# EasyEDA Pro project wukong01-Y003-HTOL.eprj, board PCB1 (continued)
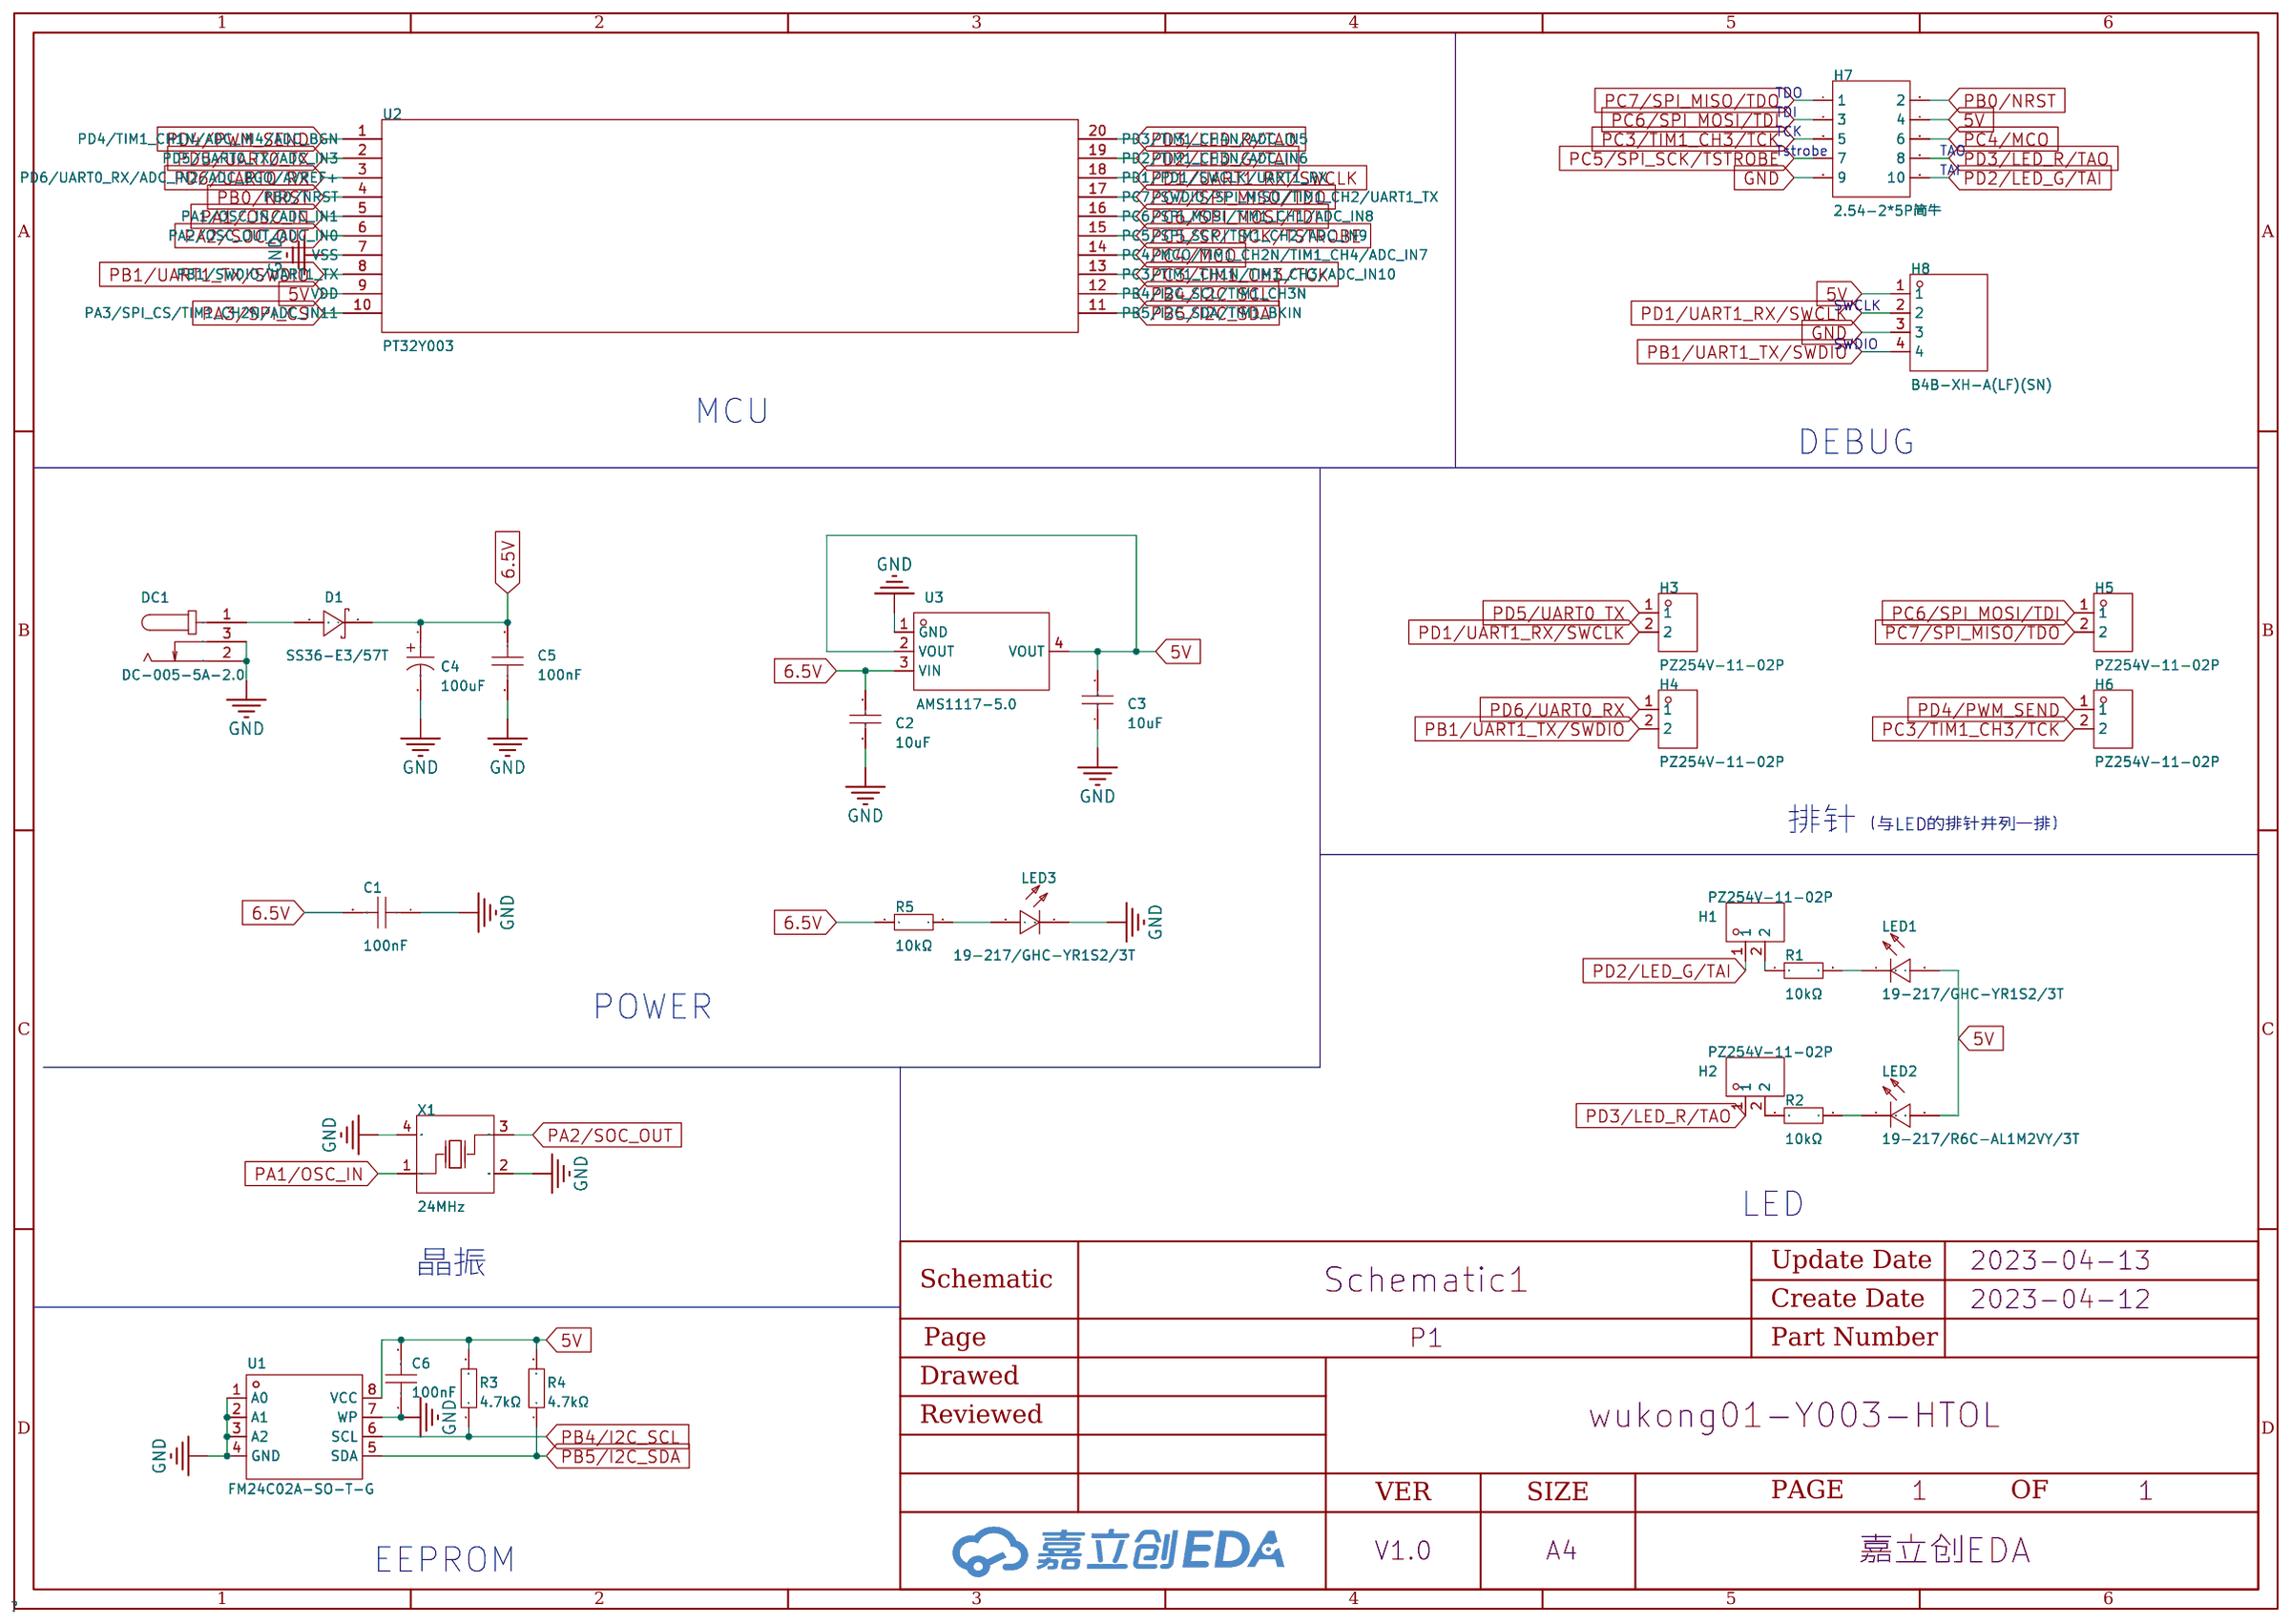
[diagram p0: schematic sheet]
## Routing (per net, layer and track width the routed paths; a pad name or vN(x,y) marks a point on that pad's centre or on a via; arc(x,y) is an arc through that point) (continued)
  Bottom Layer w0.5: v1(36.7,242.32) 36.7,249.43 36.2,249.94 31.24,249.94 30.35,250.83 H8#28.3 ; H8#11.3 30.35,79.12 31.24,78.23 36.2,78.23 36.7,77.72 v1(36.7,70.61) ; v1(157.37,211.46) 157.37,215.9 ; 303.53,87.23 303.53,47.62 300.36,44.45 11.69,44.45 10.3,43.05 v1(10.3,39.75) ; 303.53,87.23 11.56,87.23 10.3,85.97 v1(10.3,82.68) ; 303.53,87.23 303.53,130.28 ; v1(206.39,82.68) 206.39,87.12 ; H8.3 79.38,122.05 80.26,121.16 85.22,121.16 85.72,120.65 v1(85.72,113.54) ; v1(281.81,70.61) 281.81,77.72 281.31,78.23 276.35,78.23 275.46,79.12 H8#14.3 ; v1(206.39,254.38) 206.39,258.83 ; H8#29.3 79.38,207.9 80.26,207.01 85.22,207.01 85.72,206.5 v1(85.72,199.39) ; H8#7.3 79.38,293.75 80.26,292.86 85.22,292.86 85.72,292.35 v1(85.72,285.24) ; 303.53,216.02 11.73,216.02 10.3,214.59 v1(10.3,211.46) ; 303.53,216.02 303.53,258.95 ; 303.53,216.02 303.53,173.04 ; v1(134.75,285.24) 134.75,292.35 134.24,292.86 129.29,292.86 128.4,293.75 H8#9.3 ; H8#4.3 275.46,122.05 276.35,121.16 281.31,121.16 281.81,120.65 v1(281.81,113.54) ; H8#40.3 30.35,164.97 31.24,164.08 36.2,164.08 36.7,163.58 v1(36.7,156.46) ; v1(281.81,199.39) 281.81,206.5 281.31,207.01 276.35,207.01 275.46,207.9 H8#32.3 ; v1(183.77,27.69) 183.77,34.8 183.26,35.31 178.31,35.31 177.42,36.2 H8#19.3 ; H8#2.3 177.42,122.05 178.31,121.16 183.26,121.16 183.77,120.65 v1(183.77,113.54) ; v1(157.37,82.68) 157.37,87.12 ; H8#26.3 275.46,250.83 276.35,249.94 281.31,249.94 281.81,249.43 v1(281.81,242.32) ; H8#36.3 177.42,164.97 178.31,164.08 183.26,164.08 183.77,163.58 v1(183.77,156.46) ; H8#37.3 128.4,164.97 129.29,164.08 134.24,164.08 134.75,163.58 v1(134.75,156.46) ; v1(59.32,254.38) 59.32,258.83 ; v1(232.79,285.24) 232.79,292.35 232.28,292.86 227.33,292.86 226.44,293.75 H8#15.3 ; v1(157.37,125.6) 157.37,130.05 ; v1(10.3,125.6) 10.3,128.66 11.92,130.28 303.53,130.28 ; v1(281.81,285.24) 281.81,292.35 281.31,292.86 276.35,292.86 275.46,293.75 H8#10.3 ; v1(157.37,168.53) 157.37,172.97 ; H8#27.3 226.44,250.83 227.33,249.94 232.28,249.94 232.79,249.43 v1(232.79,242.32) ; H8#21.3 226.44,36.2 227.33,35.31 232.28,35.31 232.79,34.8 v1(232.79,27.69) ; v1(85.72,27.69) 85.72,34.8 85.22,35.31 80.26,35.31 79.38,36.2 H8#16.3 ; v1(108.34,211.46) 108.34,215.9 ; H8#39.3 226.44,164.97 227.33,164.08 232.28,164.08 232.79,163.58 v1(232.79,156.46) ; v1(54.1,301.75) 59.32,301.75 ; 59.32,301.75 108.34,301.75 ; 59.32,301.75 v1(59.32,297.31) ; v1(59.32,211.46) 59.32,215.9 ; v1(59.32,125.6) 59.32,130.05 ; 303.53,258.95 39.1,258.95 ; 303.53,258.95 303.53,299.47 301.24,301.75 255.41,301.75 ; 39.1,258.95 11.69,258.95 10.3,257.56 v1(10.3,254.38) ; 39.1,258.95 39.12,258.97 v1(39.12,263.27) v1(27.3,263.27) v1(21.34,263.27) ; v1(59.32,168.53) 59.32,172.97 ; 157.37,301.75 206.39,301.75 ; 157.37,301.75 v1(157.37,297.31) ; 157.37,301.75 108.34,301.75 ; 206.39,301.75 v1(206.39,297.31) ; 206.39,301.75 255.41,301.75 ; H8#34.3 30.35,207.9 31.24,207.01 36.2,207.01 36.7,206.5 v1(36.7,199.39) ; H8#8.3 177.42,293.75 178.31,292.86 183.26,292.86 183.77,292.35 v1(183.77,285.24) ; v1(183.77,199.39) 183.77,206.5 183.26,207.01 178.31,207.01 177.42,207.9 H8#30.3 ; 108.34,301.75 v1(108.34,297.31) ; H8#5.3 226.44,122.05 227.33,121.16 232.28,121.16 232.79,120.65 v1(232.79,113.54) ; v1(108.34,168.53) 108.34,172.97 ; H8#12.3 79.38,79.12 80.26,78.23 85.22,78.23 85.72,77.72 v1(85.72,70.61) ; H8#25.3 128.4,250.83 129.29,249.94 134.24,249.94 134.75,249.43 v1(134.75,242.32) ; H8#33.3 226.44,207.9 227.33,207.01 232.28,207.01 232.79,206.5 v1(232.79,199.39) ; 255.41,301.75 v1(255.41,297.31) ; H8#38.3 275.46,164.97 276.35,164.08 281.31,164.08 281.81,163.58 v1(281.81,156.46) ; v1(206.39,39.75) 206.39,44.2 ; H8#22.3 226.44,79.12 227.33,78.23 232.28,78.23 232.79,77.72 v1(232.79,70.61) ; v1(206.39,211.46) 206.39,215.9 ; 303.53,130.28 303.53,173.04 ; v1(10.3,168.53) 10.3,171.8 11.54,173.04 303.53,173.04 ; H8#31.3 128.4,207.9 129.29,207.01 134.24,207.01 134.75,206.5 v1(134.75,199.39) ; v1(255.41,82.68) 255.41,87.12 ; v1(134.75,113.54) 134.75,120.65 134.24,121.16 129.29,121.16 128.4,122.05 H8#3.3 ; v1(183.77,70.61) 183.77,77.72 183.26,78.23 178.31,78.23 177.42,79.12 H8#13.3 ; v1(85.72,156.46) 85.72,163.58 85.22,164.08 80.26,164.08 79.38,164.97 H8#35.3 ; v1(255.41,168.53) 255.41,172.97 ; H8#17.3 30.35,36.2 31.24,35.31 36.2,35.31 36.7,34.8 v1(36.7,27.69) ; H8#24.3 177.42,250.83 178.31,249.94 183.26,249.94 183.77,249.43 v1(183.77,242.32) ; v1(59.32,39.75) 59.32,44.2 ; v1(255.41,211.46) 255.41,215.9 ; H8#18.3 128.4,79.12 129.29,78.23 134.24,78.23 134.75,77.72 v1(134.75,70.61) ; v1(108.34,39.75) 108.34,44.2 ; v1(255.41,125.6) 255.41,130.05 ; v1(59.32,82.68) 59.32,87.12 ; v1(206.39,125.6) 206.39,130.05 ; v1(157.37,39.75) 157.37,44.2 ; v1(157.37,254.38) 157.37,258.83 ; v1(108.34,254.38) 108.34,258.83 ; v1(36.7,113.54) 36.7,120.65 36.2,121.16 31.24,121.16 30.35,122.05 H8#6.3 ; v1(206.39,168.53) 206.39,172.97 ; v1(108.34,82.68) 108.34,87.12 ; v1(255.41,254.38) 255.41,258.83 ; H8#23.3 79.38,250.83 80.26,249.94 85.22,249.94 85.72,249.43 v1(85.72,242.32) ; v1(134.75,27.69) 134.75,34.8 134.24,35.31 129.29,35.31 128.4,36.2 H8#20.3 ; v1(108.34,125.6) 108.34,130.05
  vias: v1(12.19,248.16) v1(12.19,247.16) v1(12.19,246.16) v1(12.19,75.95) v1(12.19,74.95) v1(12.19,73.95) v1(12.45,163.07) v1(12.45,162.07) v1(12.45,161.07) v1(12.45,119.76) v1(12.45,118.76) v1(12.45,117.76) v1(12.45,33.4) v1(12.45,32.4) v1(12.45,31.4) v1(12.57,204.98) v1(12.57,203.98) v1(12.57,202.98) v1(13.19,248.16) v1(13.19,247.16) v1(13.19,246.16) v1(13.19,75.95) v1(13.19,74.95) v1(13.19,73.95) v1(13.45,163.07) v1(13.45,162.07) v1(13.45,161.07) v1(13.45,119.76) v1(13.45,118.76) v1(13.45,117.76) v1(13.46,42.55) v1(13.46,41.55) v1(13.46,40.55) v1(13.45,33.4) v1(13.45,32.4) v1(13.45,31.4) v1(13.57,204.98) v1(13.57,203.98) v1(13.57,202.98) v1(13.59,128.65) v1(13.59,127.65) v1(13.59,126.65) v1(13.84,215.39) v1(13.84,214.39) v1(13.84,213.39) v1(13.84,86.36) v1(13.84,85.36) v1(13.84,84.36) v1(13.97,258.44) v1(13.97,257.44) v1(13.97,256.44) v1(13.97,171.96) v1(13.97,170.96) v1(13.97,169.96) v1(14.19,248.16) v1(14.19,247.16) v1(14.19,246.16) v1(14.19,75.95) v1(14.19,74.95) v1(14.19,73.95) v1(14.45,163.07) v1(14.45,162.07) v1(14.45,161.07) v1(14.45,119.76) v1(14.45,118.76) v1(14.45,117.76) v1(14.46,42.55) v1(14.46,41.55) v1(14.46,40.55) v1(14.45,33.4) v1(14.45,32.4) v1(14.45,31.4) v1(14.57,204.98) v1(14.57,203.98) v1(14.57,202.98) v1(14.59,128.65) v1(14.59,127.65) v1(14.59,126.65) v1(14.84,215.39) v1(14.84,214.39) v1(14.84,213.39) v1(14.84,86.36) v1(14.84,85.36) v1(14.84,84.36) v1(14.97,258.44) v1(14.97,257.44) v1(14.97,256.44) v1(14.97,171.96) v1(14.97,170.96) v1(14.97,169.96) v1(15.46,42.55) v1(15.46,41.55) v1(15.46,40.55) v1(15.59,128.65) v1(15.59,127.65) v1(15.59,126.65) v1(15.84,215.39) v1(15.84,214.39) v1(15.84,213.39) v1(15.84,86.36) v1(15.84,85.36) v1(15.84,84.36) v1(15.97,258.44) v1(15.97,257.44) v1(15.97,256.44) v1(15.97,171.96) v1(15.97,170.96) v1(15.97,169.96) v1(61.09,162.94) v1(61.09,161.94) v1(61.09,160.94) v1(61.09,77.47) v1(61.09,76.47) v1(61.09,75.47) v1(61.34,248.03) v1(61.34,247.03) v1(61.34,246.03) v1(61.47,33.91) v1(61.47,32.91) v1(61.47,31.91) v1(61.59,119.51) v1(61.59,118.51) v1(61.59,117.51) v1(61.72,205.23) v1(61.72,204.23) v1(61.72,203.23) v1(61.85,290.19) v1(61.85,289.19) v1(61.85,288.19) v1(61.85,42.29) v1(61.85,41.29) v1(61.85,40.29) v1(62.09,162.94) v1(62.09,161.94) v1(62.09,160.94) v1(62.09,77.47) v1(62.09,76.47) v1(62.09,75.47) v1(62.23,171.96) v1(62.23,170.96) v1(62.23,169.96) v1(62.34,248.03) v1(62.34,247.03) v1(62.34,246.03) v1(62.36,215.27) v1(62.36,214.27) v1(62.36,213.27) v1(62.36,85.73) v1(62.36,84.73) v1(62.36,83.73) v1(62.48,129.16) v1(62.48,128.16) v1(62.48,127.16) v1(62.47,33.91) v1(62.47,32.91) v1(62.47,31.91) v1(62.59,119.51) v1(62.59,118.51) v1(62.59,117.51) v1(62.74,258.57) v1(62.74,257.57) v1(62.74,256.57) v1(62.72,205.23) v1(62.72,204.23) v1(62.72,203.23) v1(62.85,290.19) v1(62.85,289.19) v1(62.85,288.19) v1(62.85,42.29) v1(62.85,41.29) v1(62.85,40.29) v1(63.09,162.94) v1(63.09,161.94) v1(63.09,160.94) v1(63.09,77.47) v1(63.09,76.47) v1(63.09,75.47) v1(63.23,171.96) v1(63.23,170.96) v1(63.23,169.96) v1(63.34,248.03) v1(63.34,247.03) v1(63.34,246.03) v1(63.36,215.27) v1(63.36,214.27) v1(63.36,213.27) v1(63.36,85.73) v1(63.36,84.73) v1(63.36,83.73) v1(63.48,129.16) v1(63.48,128.16) v1(63.48,127.16) v1(63.47,33.91) v1(63.47,32.91) v1(63.47,31.91) v1(63.59,119.51) v1(63.59,118.51) v1(63.59,117.51) v1(63.74,258.57) v1(63.74,257.57) v1(63.74,256.57) v1(63.72,205.23) v1(63.72,204.23) v1(63.72,203.23) v1(63.85,290.19) v1(63.85,289.19) v1(63.85,288.19) v1(63.85,42.29) v1(63.85,41.29) v1(63.85,40.29) v1(64.26,301.24) v1(64.26,300.24) v1(64.26,299.24) v1(64.23,171.96) v1(64.23,170.96) v1(64.23,169.96) v1(64.36,215.27) v1(64.36,214.27) v1(64.36,213.27) v1(64.36,85.73) v1(64.36,84.73) v1(64.36,83.73) v1(64.48,129.16) v1(64.48,128.16) v1(64.48,127.16) v1(64.74,258.57) v1(64.74,257.57) v1(64.74,256.57) v1(65.26,301.24) v1(65.26,300.24) v1(65.26,299.24) v1(66.26,301.24) v1(66.26,300.24) v1(66.26,299.24) v1(110.36,205.74) v1(110.36,204.74) v1(110.36,203.74) v1(110.36,162.43) v1(110.36,161.43) v1(110.36,160.43) v1(110.62,248.54) v1(110.62,247.54) v1(110.62,246.54) v1(110.62,77.09) v1(110.62,76.09) v1(110.62,75.09) v1(110.74,33.91) v1(110.74,32.91) v1(110.74,31.91) v1(110.87,290.96) v1(110.87,289.96) v1(110.87,288.96) v1(110.87,119.63) v1(110.87,118.63) v1(110.87,117.63) v1(111.12,171.83) v1(111.12,170.83) v1(111.12,169.83) v1(111.25,258.57) v1(111.25,257.57) v1(111.25,256.57) v1(111.36,205.74) v1(111.36,204.74) v1(111.36,203.74) v1(111.36,162.43) v1(111.36,161.43) v1(111.36,160.43) v1(111.38,85.22) v1(111.38,84.22) v1(111.38,83.22) v1(111.38,42.29) v1(111.38,41.29) v1(111.38,40.29) v1(111.62,248.54) v1(111.62,247.54) v1(111.62,246.54) v1(111.63,129.41) v1(111.63,128.41) v1(111.63,127.41) v1(111.62,77.09) v1(111.62,76.09) v1(111.62,75.09) v1(111.74,33.91) v1(111.74,32.91) v1(111.74,31.91) v1(111.87,290.96) v1(111.87,289.96) v1(111.87,288.96) v1(111.87,119.63) v1(111.87,118.63) v1(111.87,117.63) v1(112.01,215.39) v1(112.01,214.39) v1(112.01,213.39) v1(112.12,171.83) v1(112.12,170.83) v1(112.12,169.83) v1(112.25,258.57) v1(112.25,257.57) v1(112.25,256.57) v1(112.36,205.74) v1(112.36,204.74) v1(112.36,203.74) v1(112.36,162.43) v1(112.36,161.43) v1(112.36,160.43) v1(112.38,85.22) v1(112.38,84.22) v1(112.38,83.22) v1(112.38,42.29) v1(112.38,41.29) v1(112.38,40.29) v1(112.62,248.54) v1(112.62,247.54) v1(112.62,246.54) v1(112.63,129.41) v1(112.63,128.41) v1(112.63,127.41) v1(112.62,77.09) v1(112.62,76.09) v1(112.62,75.09) v1(112.74,33.91) v1(112.74,32.91) v1(112.74,31.91) v1(112.87,290.96) v1(112.87,289.96) v1(112.87,288.96) v1(112.87,119.63) v1(112.87,118.63) v1(112.87,117.63) v1(113.01,215.39) v1(113.01,214.39) v1(113.01,213.39) v1(113.12,171.83) v1(113.12,170.83) v1(113.12,169.83) v1(113.25,258.57) v1(113.25,257.57) v1(113.25,256.57) v1(113.38,85.22) v1(113.38,84.22) v1(113.38,83.22) v1(113.38,42.29) v1(113.38,41.29) v1(113.38,40.29) v1(113.66,301.37) v1(113.66,300.37) v1(113.66,299.37) v1(113.63,129.41) v1(113.63,128.41) v1(113.63,127.41) v1(114.01,215.39) v1(114.01,214.39) v1(114.01,213.39) v1(114.66,301.37) v1(114.66,300.37) v1(114.66,299.37) v1(115.66,301.37) v1(115.66,300.37) v1(115.66,299.37) v1(158.88,163.32) v1(158.88,162.32) v1(158.88,161.32) v1(159.38,248.67) v1(159.38,247.67) v1(159.38,246.67) v1(159.51,291.08) v1(159.51,290.08) v1(159.51,289.08) v1(159.51,205.61) v1(159.51,204.61) v1(159.51,203.61) v1(159.51,119.89) v1(159.51,118.89) v1(159.51,117.89) v1(159.51,76.58) v1(159.51,75.58) v1(159.51,74.58) v1(159.77,171.58) v1(159.77,170.58) v1(159.77,169.58) v1(159.88,163.32) v1(159.88,162.32) v1(159.88,161.32) v1(159.89,34.29) v1(159.89,33.29) v1(159.89,32.29) v1(160.15,258.32) v1(160.15,257.32) v1(160.15,256.32) v1(160.27,214.25) v1(160.27,213.25) v1(160.27,212.25) v1(160.38,248.67) v1(160.38,247.67) v1(160.38,246.67) v1(160.4,42.42) v1(160.4,41.42) v1(160.4,40.42) v1(160.51,291.08) v1(160.51,290.08) v1(160.51,289.08) v1(160.51,205.61) v1(160.51,204.61) v1(160.51,203.61) v1(160.51,119.89) v1(160.51,118.89) v1(160.51,117.89) v1(160.51,76.58) v1(160.51,75.58) v1(160.51,74.58) v1(160.77,171.58) v1(160.77,170.58) v1(160.77,169.58) v1(160.88,163.32) v1(160.88,162.32) v1(160.88,161.32) v1(160.89,34.29) v1(160.89,33.29) v1(160.89,32.29) v1(161.04,128.91) v1(161.04,127.91) v1(161.04,126.91) v1(161.04,85.98) v1(161.04,84.98) v1(161.04,83.98) v1(161.15,258.32) v1(161.15,257.32) v1(161.15,256.32) v1(161.27,214.25) v1(161.27,213.25) v1(161.27,212.25) v1(161.38,248.67) v1(161.38,247.67) v1(161.38,246.67) v1(161.4,42.42) v1(161.4,41.42) v1(161.4,40.42) v1(161.51,291.08) v1(161.51,290.08) v1(161.51,289.08) v1(161.51,205.61) v1(161.51,204.61) v1(161.51,203.61) v1(161.51,119.89) v1(161.51,118.89) v1(161.51,117.89) v1(161.51,76.58) v1(161.51,75.58) v1(161.51,74.58) v1(161.77,171.58) v1(161.77,170.58) v1(161.77,169.58) v1(161.89,34.29) v1(161.89,33.29) v1(161.89,32.29) v1(162.04,128.91) v1(162.04,127.91) v1(162.04,126.91) v1(162.04,85.98) v1(162.04,84.98) v1(162.04,83.98) v1(162.15,258.32) v1(162.15,257.32) v1(162.15,256.32) v1(162.27,214.25) v1(162.27,213.25) v1(162.27,212.25) v1(162.4,42.42) v1(162.4,41.42) v1(162.4,40.42) v1(163.07,301.37) v1(163.07,300.37) v1(163.07,299.37) v1(163.04,128.91) v1(163.04,127.91) v1(163.04,126.91) v1(163.04,85.98) v1(163.04,84.98) v1(163.04,83.98) v1(164.07,301.37) v1(164.07,300.37) v1(164.07,299.37) v1(165.07,301.37) v1(165.07,300.37) v1(165.07,299.37) v1(208.28,248.79) v1(208.28,247.79) v1(208.28,246.79) v1(208.28,162.18) v1(208.28,161.18) v1(208.28,160.18) v1(208.53,120.27) v1(208.53,119.27) v1(208.53,118.27) v1(208.79,34.16) v1(208.79,33.16) v1(208.79,32.16) v1(208.91,205.23) v1(208.91,204.23) v1(208.91,203.23) v1(209.04,291.08) v1(209.04,290.08) v1(209.04,289.08) v1(209.04,76.96) v1(209.04,75.96) v1(209.04,74.96) v1(209.17,214) v1(209.17,213) v1(209.17,212) v1(209.28,248.79) v1(209.28,247.79) v1(209.28,246.79) v1(209.28,162.18) v1(209.28,161.18) v1(209.28,160.18) v1(209.42,171.32) v1(209.42,170.32) v1(209.42,169.32) v1(209.42,128.91) v1(209.42,127.91) v1(209.42,126.91) v1(209.53,120.27) v1(209.53,119.27) v1(209.53,118.27) v1(209.68,258.32) v1(209.68,257.32) v1(209.68,256.32) v1(209.79,34.16) v1(209.79,33.16) v1(209.79,32.16) v1(209.91,205.23) v1(209.91,204.23) v1(209.91,203.23) v1(210.04,291.08) v1(210.04,290.08) v1(210.04,289.08) v1(210.04,76.96) v1(210.04,75.96) v1(210.04,74.96) v1(210.17,214) v1(210.17,213) v1(210.17,212) v1(210.28,248.79) v1(210.28,247.79) v1(210.28,246.79) v1(210.28,162.18) v1(210.28,161.18) v1(210.28,160.18) v1(210.31,44.07) v1(210.31,43.07) v1(210.31,42.07) v1(210.42,171.32) v1(210.42,170.32) v1(210.42,169.32) v1(210.42,128.91) v1(210.42,127.91) v1(210.42,126.91) v1(210.53,120.27) v1(210.53,119.27) v1(210.53,118.27) v1(210.57,85.47) v1(210.57,84.47) v1(210.57,83.47) v1(210.68,258.32) v1(210.68,257.32) v1(210.68,256.32) v1(210.79,34.16) v1(210.79,33.16) v1(210.79,32.16) v1(210.95,301.5) v1(210.95,300.5) v1(210.95,299.5) v1(210.91,205.23) v1(210.91,204.23) v1(210.91,203.23) v1(211.04,291.08) v1(211.04,290.08) v1(211.04,289.08) v1(211.04,76.96) v1(211.04,75.96) v1(211.04,74.96) v1(211.17,214) v1(211.17,213) v1(211.17,212) v1(211.31,44.07) v1(211.31,43.07) v1(211.31,42.07) v1(211.42,171.32) v1(211.42,170.32) v1(211.42,169.32) v1(211.42,128.91) v1(211.42,127.91) v1(211.42,126.91) v1(211.57,85.47) v1(211.57,84.47) v1(211.57,83.47) v1(211.68,258.32) v1(211.68,257.32) v1(211.68,256.32) v1(211.95,301.5) v1(211.95,300.5) v1(211.95,299.5) v1(212.31,44.07) v1(212.31,43.07) v1(212.31,42.07) v1(212.57,85.47) v1(212.57,84.47) v1(212.57,83.47) v1(212.95,301.5) v1(212.95,300.5) v1(212.95,299.5) v1(257.43,205.99) v1(257.43,204.99) v1(257.43,203.99) v1(257.56,291.08) v1(257.56,290.08) v1(257.56,289.08) v1(257.68,248.67) v1(257.68,247.67) v1(257.68,246.67) v1(257.94,162.81) v1(257.94,161.81) v1(257.94,160.81) v1(257.94,119.63) v1(257.94,118.63) v1(257.94,117.63) v1(258.19,77.22) v1(258.19,76.22) v1(258.19,75.22) v1(258.43,205.99) v1(258.43,204.99) v1(258.43,203.99) v1(258.56,291.08) v1(258.56,290.08) v1(258.56,289.08) v1(258.68,248.67) v1(258.68,247.67) v1(258.68,246.67) v1(258.7,258.19) v1(258.7,257.19) v1(258.7,256.19) v1(258.7,129.29) v1(258.7,128.29) v1(258.7,127.29) v1(258.83,301.37) v1(258.83,300.37) v1(258.83,299.37) v1(258.83,171.2) v1(258.83,170.2) v1(258.83,169.2) v1(258.94,162.81) v1(258.94,161.81) v1(258.94,160.81) v1(258.94,119.63) v1(258.94,118.63) v1(258.94,117.63) v1(259.19,77.22) v1(259.19,76.22) v1(259.19,75.22) v1(259.21,213.87) v1(259.21,212.87) v1(259.21,211.87) v1(259.33,85.34) v1(259.33,84.34) v1(259.33,83.34) v1(259.43,205.99) v1(259.43,204.99) v1(259.43,203.99) v1(259.56,291.08) v1(259.56,290.08) v1(259.56,289.08) v1(259.68,248.67) v1(259.68,247.67) v1(259.68,246.67) v1(259.7,258.19) v1(259.7,257.19) v1(259.7,256.19) v1(259.7,129.29) v1(259.7,128.29) v1(259.7,127.29) v1(259.83,301.37) v1(259.83,300.37) v1(259.83,299.37) v1(259.83,171.2) v1(259.83,170.2) v1(259.83,169.2) v1(259.94,162.81) v1(259.94,161.81) v1(259.94,160.81) v1(259.94,119.63) v1(259.94,118.63) v1(259.94,117.63) v1(260.19,77.22) v1(260.19,76.22) v1(260.19,75.22) v1(260.21,213.87) v1(260.21,212.87) v1(260.21,211.87) v1(260.33,85.34) v1(260.33,84.34) v1(260.33,83.34) v1(260.7,258.19) v1(260.7,257.19) v1(260.7,256.19) v1(260.7,129.29) v1(260.7,128.29) v1(260.7,127.29) v1(260.83,301.37) v1(260.83,300.37) v1(260.83,299.37) v1(260.83,171.2) v1(260.83,170.2) v1(260.83,169.2) v1(261.21,213.87) v1(261.21,212.87) v1(261.21,211.87) v1(261.33,85.34) v1(261.33,84.34) v1(261.33,83.34)
